# EasyEDA Pro project foc_opam.eprj, board PCB1
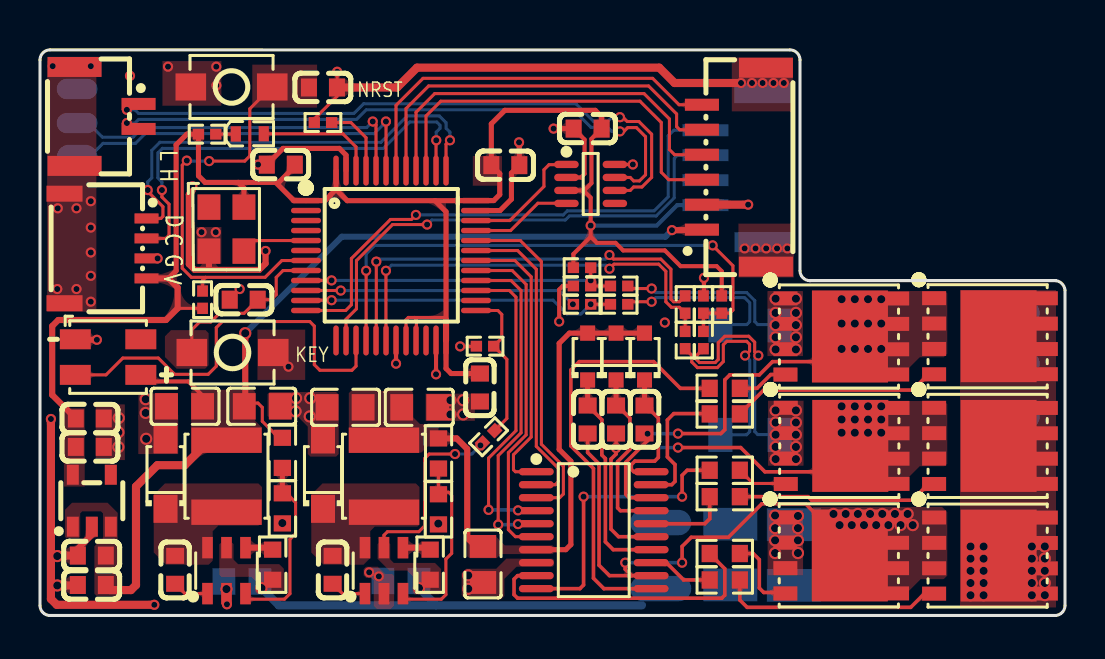
[diagram p1: board, top side]
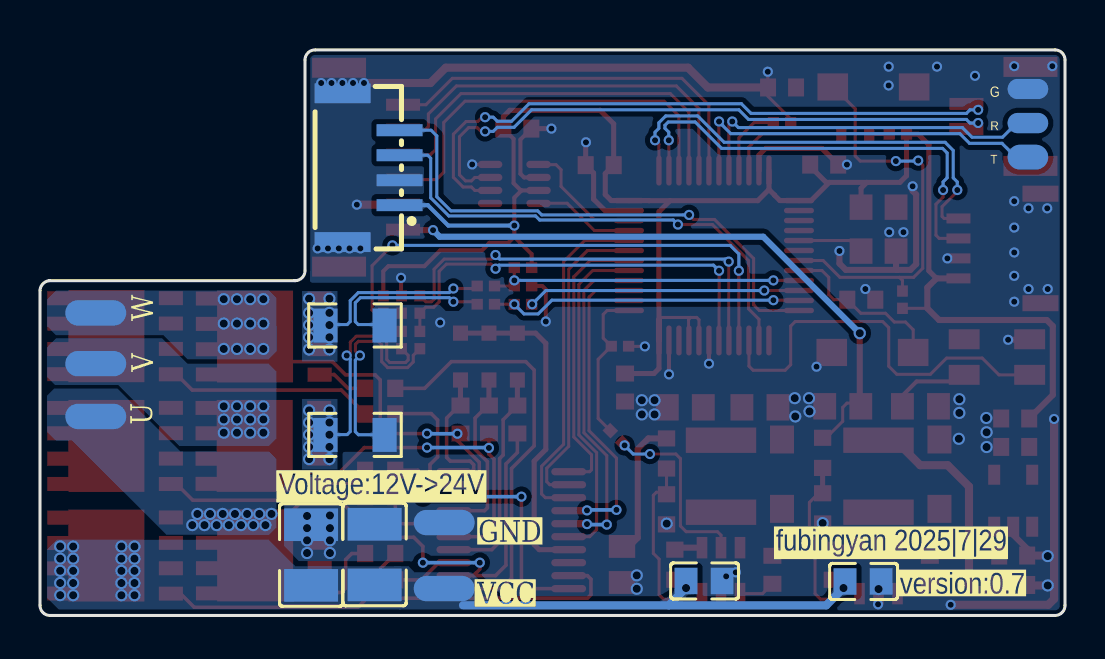
[diagram p2: board, bottom side, seen from below]

Outline 51.25 x 28.3 mm; copper layers: Top Layer, Bottom Layer. Coordinates in mm from the lower left corner of the outline.
Outline path: 0,27.8 arc(0.15,28.15) 0.5,28.3 37.49,28.3 arc(37.85,28.15) 38,27.79 38,17.25 arc(38.15,16.9) 38.5,16.75 50.8,16.75 arc(51.11,16.59) 51.25,16.27 51.25,0.5 arc(51.1,0.15) 50.75,0 0.5,0 arc(0.15,0.15) 0,0.5 0,27.8
Stack: Top Layer 0.035mm / Dielectric1 1.51mm FR4 er 4.5 / Bottom Layer 0.035mm

## Design rules (mm)
net SWD: DP2
net SWC: DP2
net H: DP1
net L: DP1
template: 自定义配置
spacing copperThickness1oz (default): track to track 0.102, other pairs 0.152 to 0.3
spacing copperThickness2oz: track to track 0.203, other pairs 0.152 to 0.3
track width copperThickness1oz (default): min 0.127, default 0.254, max 2.54
track width copperThickness2oz: min 0.203, default 0.254, max 2.54
differential pair differentialPair (default): width min 0.127, default 0.152, max 2.54; gap min 0.152, default 0.152
via viaSize (default): diameter min 0.5, default 0.61, max 10; hole min 0.3, default 0.305, max 6.3
net GND uses copperRegion1

## Placement (name value [footprint] x y rotation side)
C1  100nF  [C0603]  10.19 15.8 180 top
C2  100nF  [C0603]  2.49 8.43 180 top
C3  10uF  [C0603]  2.49 9.86 180 top
C4  10uF  [C0603]  2.59 3 0 top
C5  100nF  [C0603]  2.59 1.52 0 top
C6  100nF  [C0603]  6.76 2.29 90 top
C7  10uF  [C0805]  11.12 10.47 180 top
C8  1uF  [C0805]  7.21 10.47 0 top
C9  100nF  [C0603]  27.38 24.36 0 top
C10  100nF  [C0603_1]  12.04 22.56 0 top
C11  100nF  [C0603_1]  22 11.4 90 top
C12  100nF  [C0603]  14.63 2.29 90 top
C13  100nF  [C0603_1]  23.27 22.53 180 top
C14  10uF  [C0805]  15.24 10.41 0 top
C15  1uF  [C0805]  19 10.41 180 top
C16  10uF  [C0805]  22.15 2.54 90 top
C17  1uF  [C0603]  27.38 9.8 270 top
C18  1uF  [C0603]  28.8 9.8 270 top
C19  1uF  [C0603]  30.23 9.8 270 top
C20  10uF  [C1210]  34.52 3.05 270 bottom
C21  10uF  [C1210]  37.69 3.02 270 bottom
C22  10nF  [C0603]  14.15 26.42 0 top
C23  10uF  [C0805]  18.06 1.73 180 bottom
C24  10uF  [C0805]  10.11 1.7 180 bottom
CN1  HDGC1002WR-S-4P  [CONN-SMD_4P-P1.00_HDGC_HDGC1002WR-S-4P]  3.28 18.36 270 top
CN3  GH1.25-2P卧贴  [CONN-SMD_2P-P1.25_X1251WRS-02HF-LPSW]  3.33 24.97 270 top
D1  DSK210  [SOD-123FL_L2.7-W1.8-LS3.8-RD]  6.28 7.07 90 top
D2  DSK210  [SOD-123FL_L2.7-W1.8-LS3.8-RD]  14.15 7.07 90 top
D3  B5819WS  [SOD-323_L1.8-W1.3-LS2.5-RD]  27.38 12.95 90 top
D4  B5819WS  [SOD-323_L1.8-W1.3-LS2.5-RD]  28.8 12.95 90 top
D5  B5819WS  [SOD-323_L1.8-W1.3-LS2.5-RD]  30.23 12.95 90 top
L1  3.3uH  [IND-SMD_L4.0-W4.0_SMNR4020]  9.32 6.97 270 top
L2  3.3uH  [IND-SMD_L4.0-W4.0_SMNR4020]  17.2 6.97 270 top
LED1  YLED0603R  [LED_0603]  10.49 24.1 0 top
LED2  WS2812B-Mini  [LED-SMD_4P-L3.5-W3.5-TL_WS2812B]  3.4 12.93 180 top
NOREF  -  [Pad_e789]  48.46 9.96 0 top
NOREF#2  -  [Pad_e786]  48.46 15.14 0 top
NOREF#3  -  [Pad_e3962]  1.86 26.34 0 top
NOREF#4  -  [Pad_e2611]  31.04 1.35 180 top
NOREF#5  -  [Pad_e788]  48.46 12.6 0 top
NOREF#6  -  [Pad_e1284]  31.04 4.65 180 top
R  -  [Test-Point-0.5mm]  1.86 24.64 270 bottom
R1  10kΩ  [R0402]  14.15 24.66 180 top
R2  2.2Ω  [R0603]  34.24 10.08 0 top
R3  10kΩ  [R0402]  8.36 24.08 180 top
R4  10mΩ  [R1206]  35.5 14.51 0 bottom
R5  10mΩ  [R1206]  35.5 9.03 0 bottom
R6  10kΩ  [R0402]  8.13 15.8 90 top
R8  1kΩ  [R0603]  12.12 5.36 90 top
R9  5.1kΩ  [R0603]  12.12 8.14 270 top
R10  100k  [R0603]  11.63 2.54 90 top
R11  22kΩ  [R0402]  27.1 17.4 180 top
R12  22kΩ  [R0402]  34.09 15.56 90 top
R13  750Ω  [R0603]  19.92 5.31 90 top
R14  10kΩ  [R0603]  19.92 8.1 270 top
R15  100k  [R0603]  19.51 2.54 90 top
R16  1.5kΩ  [R0402]  28.96 16.48 0 top
R17  1.5kΩ  [R0402]  33.17 13.78 270 top
R18  22kΩ  [R0402]  27.1 16.48 0 top
R19  22kΩ  [R0402]  33.17 15.56 270 top
R20  1.5kΩ  [R0402]  28.96 15.57 0 top
R21  11kΩ  [R0402]  27.1 15.57 0 top
R22  1.5kΩ  [R0402]  32.26 13.78 270 top
R23  11kΩ  [R0402]  32.26 15.56 270 top
R24  22kΩ  [R0402]  22.43 8.94 45 top
R25  1kΩ  [R0402]  22.25 13.47 0 top
SW1  轻触按键3*4*H  [SW-SMD_L4.0-W2.9-LS5.0]  9.63 13.16 0 top
SW2  轻触按键3*4*H  [SW-SMD_L4.0-W2.9-LS5.0]  9.58 26.44 180 top
T  -  [Test-Point-0.5mm#2]  1.86 22.93 180 bottom
U1  -  [SOT-23-5_L3.0-W1.7-P0.95-LS2.8-BR]  2.59 5.74 270 top
U2  CJAC130SN04  [PDFN-8_L5.8-W4.9-P1.27-LS6.1-BL]  47.5 13.97 270 top
U3  CJAC130SN04  [PDFN-8_L5.8-W4.9-P1.27-LS6.1-BL]  47.5 8.48 270 top
U4  CJAC130SN04  [PDFN-8_L5.8-W4.9-P1.27-LS6.1-BL]  47.5 3 270 top
U5  STM32G431CBT6  [LQFP-48_L7.0-W7.0-P0.50-LS9.0-BL]  17.55 18.01 270 top
U6  2.2R  [R0603]  34.24 5.94 0 top
U7  2.2R  [R0603]  34.24 1.78 0 top
U8  CJAC130SN04  [PDFN-8_L5.8-W4.9-P1.27-LS6.1-BL]  40.06 13.96 270 top
U9  CJAC130SN04  [PDFN-8_L5.8-W4.9-P1.27-LS6.1-BL]  40.08 8.48 270 top
U10  CJAC130SN04  [PDFN-8_L5.8-W4.9-P1.27-LS6.1-BL]  40.06 3 270 top
U11  2.2R  [R0603]  34.24 3.1 0 top
U12  2.2R  [R0603]  34.24 11.36 0 top
U13  2.2R  [R0603]  34.24 7.26 0 top
U15  TD1466TR  [SOT-23-6_L2.9-W1.6-P0.95-LS2.8-BL]  9.32 2.24 0 top
U16  MAX3051EKA+T  [SOT-23-8_L3.0-W1.7-P0.65-LS2.8-TL]  27.53 21.59 0 top
U18  TD1466TR  [SOT-23-6_L2.9-W1.6-P0.95-LS2.8-BL]  17.2 2.24 0 top
U19  FD6288T  [TSSOP-20_L6.5-W4.4-P0.65-LS6.4-BL]  27.69 4.27 270 top
U20  XY-GH1.25-6A61  [CONN-SMD_6P-P1.25_XYECONN_XY-GH1.25-6A61]  34.7 22.43 90 top
U21  GH1.25-4P卧贴  [CONN-SMD_4P-P1.25_GH1.25-4P]  34.7 22.4 270 bottom
X1  8MHz  [OSC-SMD_4P-L3.2-W2.5-BL]  9.32 19.33 270 top

## Footprints (pads in the part's own frame, mm; a bottom-side part is the same pattern mirrored in y, then rotated)
C0603
  rect 0.8x0.9 smd: 1(-0.7,0) 2(0.7,0)
C0603_1
  rect 0.8x0.9 smd: 1(-0.7,0) 2(0.7,0)
C0805
  rect 1.143x1.321 smd: 1(-0.889,0) 2(0.914,0)
C1210
  rect 1.635x2.7 smd: 1(-1.518,0) 2(1.518,0)
CONN-SMD_2P-P1.25_X1251WRS-02HF-LPSW
  rect 0.6x1.7 smd: 1(-0.625,1.6) 2(0.625,1.6)
  rect 1x2.7 smd: 3(2.475,-1.6) 4(-2.475,-1.6)
CONN-SMD_4P-P1.00_HDGC_HDGC1002WR-S-4P
  rect 0.5x1.2 smd: 1(-1.5,2.05) 2(-0.5,2.05) 3(0.5,2.05) 4(1.5,2.05)
  rect 0.8x1.8 smd: 5(2.741,-2.05) 6(-2.739,-2.05)
CONN-SMD_4P-P1.25_GH1.25-4P
  rect 0.6x2.3 smd: 1(1.875,1.425) 2(0.625,1.425) 3(-0.625,1.425) 4(-1.875,1.425)
  rect 1x2.8 smd: 5(-3.725,-1.425) 6(3.725,-1.425)
CONN-SMD_6P-P1.25_XYECONN_XY-GH1.25-6A61
  rect 0.6x1.7 smd: 1(-3.125,1.6) 2(-1.875,1.6) 3(-0.625,1.6) 4(0.625,1.6) 5(1.875,1.6) 6(3.125,1.6)
  rect 1x2.7 smd: 7(4.975,-1.6) 8(-4.975,-1.6)
IND-SMD_L4.0-W4.0_SMNR4020
  rect 1.27x3.521 smd: 1(1.801,0) 2(-1.801,0)
LED-SMD_4P-L3.5-W3.5-TL_WS2812B
  rect 1.545x0.997 smd: 1(-1.637,0.89) 2(-1.637,-0.89) 3(1.637,-0.89) 4(1.637,0.89)
LED_0603
  rect 0.508x0.762 smd: 1(-0.699,-0.01) 2(0.699,-0.005)
LQFP-48_L7.0-W7.0-P0.50-LS9.0-BL
  oval 0.27x1.5 smd: 1(-2.75,-4.25) 2(-2.25,-4.25) 3(-1.75,-4.25) 4(-1.25,-4.25) 5(-0.75,-4.25) 6(-0.25,-4.25) 7(0.25,-4.25) 8(0.75,-4.25) 9(1.25,-4.25) 10(1.75,-4.25) 11(2.25,-4.25) 12(2.75,-4.25) 25(2.75,4.25) 26(2.25,4.25) 27(1.75,4.25) 28(1.25,4.25) 29(0.75,4.25) 30(0.25,4.25) 31(-0.25,4.25) 32(-0.75,4.25) 33(-1.25,4.25) 34(-1.75,4.25) 35(-2.25,4.25) 36(-2.75,4.25)
  oval 1.5x0.27 smd: 13(4.25,-2.75) 14(4.25,-2.25) 15(4.25,-1.75) 16(4.25,-1.25) 17(4.25,-0.75) 18(4.25,-0.25) 19(4.25,0.25) 20(4.25,0.75) 21(4.25,1.25) 22(4.25,1.75) 23(4.25,2.25) 24(4.25,2.75) 37(-4.25,2.75) 38(-4.25,2.25) 39(-4.25,1.75) 40(-4.25,1.25) 41(-4.25,0.75) 42(-4.25,0.25) 43(-4.25,-0.25) 44(-4.25,-0.75) 45(-4.25,-1.25) 46(-4.25,-1.75) 47(-4.25,-2.25) 48(-4.25,-2.75)
OSC-SMD_4P-L3.2-W2.5-BL
  rect 1.27x1.143 smd: 1(-1.1,-0.875) 2(1.1,-0.875) 3(1.1,0.875) 4(-1.1,0.875)
Pad_e786
  oval 3.048x1.27 smd far side: 1(0,0)
Pad_e788
  oval 3.048x1.27 smd far side: 1(0,0)
Pad_e789
  oval 3.048x1.27 smd far side: 1(0,0)
Pad_e1284
  oval 3.048x1.27 smd far side: 1(0,0)
Pad_e2611
  oval 3.048x1.27 smd far side: 1(0,0)
Pad_e3962
  oval 2.032x1.016 smd far side: 2(0,0)
PDFN-8_L5.8-W4.9-P1.27-LS6.1-BL
  rect 0.7x1.2 smd: 1(-1.905,-2.792) 2(-0.635,-2.792) 3(0.635,-2.792) 4(1.905,-2.792) 5(1.9,2.792) 6(0.64,2.792) 7(-0.63,2.792) 8(-1.9,2.792)
  rect 4.6x3.8 smd: 9(0,0.432)
R0402
  rect 0.566x0.54 smd: 1(-0.433,0) 2(0.433,0)
R0603
  rect 0.806x0.864 smd: 1(-0.753,0) 2(0.753,0)
R1206
  rect 1.208x1.701 smd: 1(-1.479,0) 2(1.479,0)
SOD-123FL_L2.7-W1.8-LS3.8-RD
  rect 1.399x1.199 smd: 1(-1.735,0) 2(1.735,0)
SOD-323_L1.8-W1.3-LS2.5-RD
  rect 0.762x0.75 smd: 1(-1.173,0) 2(1.173,0)
SOT-23-5_L3.0-W1.7-P0.95-LS2.8-BR
  rect 1x0.6 smd: 1(1.3,-0.95) 2(1.3,0) 3(1.3,0.95) 4(-1.3,0.95) 5(-1.3,-0.95)
SOT-23-6_L2.9-W1.6-P0.95-LS2.8-BL
  rect 0.532x1.072 smd: 1(-0.95,-1.149) 2(0,-1.149) 3(0.95,-1.149) 4(0.95,1.149) 5(0,1.149) 6(-0.95,1.149)
SOT-23-8_L3.0-W1.7-P0.65-LS2.8-TL
  oval 1.222x0.364 smd: 1(-1.211,0.975) 2(-1.211,0.325) 3(-1.211,-0.325) 4(-1.211,-0.975) 5(1.211,-0.975) 6(1.211,-0.325) 7(1.211,0.325) 8(1.211,0.975)
SW-SMD_L4.0-W2.9-LS5.0
  rect 1.53x1.36 smd: 1(-2.035,0) 2(2.035,0)
Test-Point-0.5mm
  oval 1.016x2.032 smd: 1(0,0)
Test-Point-0.5mm#2
  oval 2.032x1.244 smd: 1(0,0)
TSSOP-20_L6.5-W4.4-P0.65-LS6.4-BL
  oval 0.364x1.742 smd: 1(-2.925,-2.871) 2(-2.275,-2.871) 3(-1.625,-2.871) 4(-0.975,-2.871) 5(-0.325,-2.871) 6(0.325,-2.871) 7(0.975,-2.871) 8(1.625,-2.871) 9(2.275,-2.871) 10(2.925,-2.871) 11(2.925,2.871) 12(2.275,2.871) 13(1.625,2.871) 14(0.975,2.871) 15(0.325,2.871) 16(-0.325,2.871) 17(-0.975,2.871) 18(-1.625,2.871) 19(-2.275,2.871) 20(-2.925,2.871)

## Nets
As in the schematic, except:
GND: C1.2 C2.1 C3.1 C4.1 C5.1 C7.1 C8.1 C9.1 C10.1 C11.1 C13.1 C14.1 C15.1 C16.1 C20.1 C21.1 C22.2 C23.2 C24.2 CN1.3 CN1.5 CN1.6 CN3.3 CN3.4 D1.2 D2.2 LED2.3 NOREF#3.2 NOREF#6.1 R1.2 R4.1 R5.1 R8.1 R13.1 R18.1 R19.1 R20.2 R22.2 R25.1 SW1.2 SW2.2 U1.2 U5.19 U5.23 U5.35 U5.47 U10.1 U10.2 U10.3 U15.2 U16.2 U16.8 U18.2 U19.8 U20.2 U20.7 U20.8 U21.2 U21.5 U21.6 X1.2
VCC: C20.2 C21.2 C23.1 C24.1 NOREF#4.1 R10.1 R15.1 R24.1 U2.5 U2.6 U2.7 U2.8 U2.9 U3.5 U3.6 U3.7 U3.8 U3.9 U4.5 U4.6 U4.7 U4.8 U4.9 U15.5 U18.5
SHA: C19.2 NOREF#2.1 U2.1 U2.2 U2.3 U8.5 U8.6 U8.7 U8.8 U8.9 U19.18
SHB: C18.2 NOREF#5.1 U3.1 U3.2 U3.3 U9.5 U9.6 U9.7 U9.8 U9.9 U19.15
SHC: C17.2 NOREF.1 U4.1 U4.2 U4.3 U10.5 U10.6 U10.7 U10.8 U10.9 U19.12
U1R: R.1 U5.44
U1T: T.1 U5.43

Pads without a net: LED2 2; U1 4; U5 2 3 4 6 13 22 26; U16 5; X1 1

## Via types
v1: diameter 0.508, hole 0.305, Top Layer to Bottom Layer, 96 vias
v2: diameter 0.61, hole 0.406, Top Layer to Bottom Layer, 110 vias

## Routing (per net, layer and track width the routed paths; a pad name or vN(x,y) marks a point on that pad's centre or on a via; arc(x,y) is an arc through that point)
3.3V: length 94.2
  Top Layer w0.152: 18.72,14.91 18.82,14.81 18.82,13.78 U5.21 ; 18.72,14.91 20.19,14.91 20.3,14.8 ; 18.72,14.91 18.41,14.91 18.3,14.8 U5.20 ; R6.1 6.93,15.37
  Top Layer w0.203: 27.17,21.27 27.21,21.27 27.57,21.63 27.57,23.85 C9.2 ; 27.17,21.27 U16.3 ; 27.17,21.27 27.53,20.9 v1(27.53,19.51) 27.53,18.95 ; 27.53,18.95 27.84,18.64 28.78,18.64 29.16,18.26 31.24,18.26 32.03,17.47 33.83,17.47 34.09,17.22 R12.2 ; 27.53,18.95 26.67,18.08 R11.2
  Top Layer w0.254: 14.8,21.31 U5.48 ; 14.8,21.31 15.36,20.75 19.75,20.75 ; 14.8,21.31 14.52,21.04 14.52,21.03 14.26,20.76 U5.1 12.69,20.76 11.79,21.67 ; 9.91,21.67 11.79,21.67 ; 9.91,21.67 8.25,21.67 7.92,22 R3.2 7.34,24.08 6.81,23.55 6.81,17.25 6.42,16.86 ; 9.91,21.67 10.2,21.38 X1.4 ; 11.79,21.67 11.94,21.67 12.74,22.47 C10.2 ; 20.3,14.8 20.3,20.2 19.75,20.75 ; C9.2 28.08,24.95 27.76,25.27 23.24,25.27 22.57,24.6 C13.2 22.99,22.11 22.99,21.06 22.69,20.76 U5.36 20.8,20.76 20.79,20.75 19.75,20.75 ; U5.24 20.3,12.36 20.56,12.1 C11.2
  Top Layer w0.305: CN1.4 6.42,16.86 6.88,16.41 6.88,15.37 6.3,14.78 0.91,14.78 0.61,14.48 0.61,11.03 C3.2 ; 20.3,14.8 U5.24
  Bottom Layer w0.203: v1(27.53,19.51) 30.84,19.51 31.86,20.53 U21.1
+5V: length 48.1
  Top Layer w0.152: 10.16,10.62 10.9,10.62 11.12,10.41 11.12,9.71 11.74,9.09 12.12,9.09
  Top Layer w0.203: LED2.1 5.37,11.71 7.42,11.71 8.4,10.73 C8.2
  Top Layer w0.305: U20.1 33.07,19.28 v1(31.6,19.28) ; 10.21,10.47 10.26,10.52 v2(10.26,14.12)
  Top Layer w0.406: C5.2 3.29,1.48 3.5,1.27 4.55,1.27 4.8,1.52 4.8,6.45 5.87,7.52 7.24,7.52 8.49,8.77 L1.2
  Bottom Layer w0.305: v1(31.6,19.28) 31.27,18.95 15.09,18.95 v2(10.26,14.12)
+12V: length 23.9
  Top Layer w0.152: 18.09,10.88 18.06,10.88
  Top Layer w0.254: U19.7 26.29,3.29 26.54,3.55 26.54,7.72 25.96,8.31 25.96,13.61 26.47,14.13 D3.2 D4.2 D5.2
  Top Layer w0.305: 21.9,3.35 21.36,3.89 21.36,8.33 20.83,8.86 R14.1 ; 18.09,10.88 18.09,10.52
GND: length 99.4
  Top Layer w0.152: U16.8 v1(29.64,22.56) ; R1.2 13.72,24.84 14.85,25.97 C22.2 14.86,26.43 v1(14.86,27.2) ; R22.2 32.59,13.02 32.59,12.68 32.87,12.4 33.87,12.4 34.17,12.7 34.17,13.54 34.34,13.72 35.33,13.72 35.48,13.57 35.48,13.23 v1(35.25,13) ; v1(21.01,13.46) 21.81,13.46 R25.1 ; R20.2 29.52,15.7 v1(30.58,15.7)
  Top Layer w0.203: R19.1 33.2,16.01 33.2,16.89 ; U5.23 v1(19.8,12.06) ; U5.19 v1(17.8,12.6) ; R18.1 26.14,16.48 25.96,16.31 v1(25.96,14.71) ; U16.2 27.05,21.92 27.23,22.1 27.23,23.81 C9.1
  Top Layer w0.254: v1(12.42,12.45) 12.37,12.45 SW1.2 ; U5.47 15.3,23.03 14.97,23.37 12.15,23.37 C10.1 ; U5.35 23,20.26 23.57,20.83 23.57,22.13 C13.1 23.97,23.66 v1(23.95,23.67) ; v1(25.68,24.36) C9.1
  Top Layer w0.305: 1.89,3 1.89,3.34 2.59,4.04 U1.2 ; LED2.3 1.79,13.79 v1(2.84,13.79) ; X1.2 8.45,17.34 8.4,17.29 ; 8.4,17.29 7.73,17.29 7.44,17.58 7.44,21.06 7.62,21.24 v1(7.62,21.47) ; 8.4,17.29 10.96,17.29 11.28,17.61 v1(11.28,18.24)
  Top Layer w0.406: v1(5.72,0.53) 0.84,0.53 0.55,0.83 v1(0.55,9.83) ; v2(0.86,2.97) 0.89,3 1.89,3 ; U20.2 v1(35.41,20.55) ; C22.2 17.86,26.42 18.85,27.41 30.96,27.41 31.73,26.64 v1(35.05,26.64) ; v2(0.86,1.5) 1.87,1.5 1.89,1.52
  Bottom Layer w0.152: v1(30.58,15.7) 30.78,15.9 35.23,15.9 35.48,15.65 35.48,14.7 35.34,14.55 34.58,14.55 34.02,14 ; 33.64,8.5 34.18,9.04 35.33,9.04 35.48,9.19 35.48,12.78 v1(35.25,13)
  vias: v1(0.64,27.48) v1(0.89,20.37) v1(0.86,16.33) v1(1.82,20.37) v1(1.82,16.33) v1(2.54,27.48) v1(2.54,20.73) v1(2.54,19.41) v1(2.54,18.16) v1(2.54,16.99) v1(2.54,15.7) v1(4.5,27) v1(5.88,17.86) v1(6.4,27.46) v1(8.08,19.18) v1(8.81,27.46) v1(8.82,26.52) v1(8.79,19.18) v1(9.35,0.56) v1(9.98,16.33) v1(10.9,22.56) v1(16.46,2.16) v1(16.94,1.96) v1(31.24,14.66) v1(33.2,16.89) v1(35.23,18.36) v1(35.6,26.64) v1(35.78,18.36) v1(36.13,26.64) v1(36.31,18.36) v1(36.67,26.64) v1(36.85,18.36) v1(37.19,26.64) v1(37.37,18.36) v2(3.94,9.88) v2(3.92,9.17) v2(3.92,8.43) v2(5.28,10.82) v2(5.28,10.13) v2(5.31,8.84) v2(9.32,1.32) v2(12.12,4.62) v2(12.8,10.87) v2(12.78,10.21) v2(13.51,10.87) v2(13.49,9.96) v2(19.91,4.6) v2(20.52,10.77) v2(20.52,10.06) v2(21.16,10.77) v2(21.16,10.06) v2(21.41,2.01) v2(21.41,1.34) v2(36.75,5) v2(36.75,4.37) v2(36.75,3.76) v2(36.75,3.12) v2(37.9,4.98) v2(37.9,4.37) v2(37.9,3.76) v2(37.9,3.12)
VCC: length 29.9
  Top Layer w0.152: U18.5 17.2,4.02 17.37,4.19 18.94,4.19 19.23,4.48 19.23,7.85 19.46,8.08 v1(20.75,8.08)
  Bottom Layer w0.152: v1(20.75,8.08) 21.59,8.08 v1(22.02,8.51)
  Bottom Layer w0.406: v2(11.07,1.37) 11.94,0.51 19.81,0.51 ; 19.81,0.51 30.1,0.51 ; 19.81,0.51 v2(18.95,1.37)
  vias: v2(46.53,3.45) v2(46.53,2.84) v2(46.53,2.23) v2(46.53,1.62) v2(46.53,1.01) v2(47.18,3.45) v2(47.18,2.84) v2(47.18,2.23) v2(47.18,1.62) v2(47.18,1.01) v2(49.59,3.45) v2(49.59,2.84) v2(49.59,2.23) v2(49.59,1.62) v2(49.59,1.01) v2(50.24,3.45) v2(50.24,2.84) v2(50.24,2.23) v2(50.24,1.63) v2(50.24,1.02)
CAN_RX: length 5.3
  Top Layer w0.152: 26.54,20.62 24.9,20.62 23.53,19.26 U5.33
CAN_TX: length 6.4
  Top Layer w0.152: 26.52,22.56 25.45,22.56 25.2,22.3 25.2,21.46 23.49,19.76 U5.34
CLK: length 19.8
  Top Layer w0.152: 33.1,23.05 31.73,23.05 31.47,23.31 31.47,24.84 30.2,26.11 19.74,26.11 18.8,25.18 U5.40
CSN: length 19.9
  Top Layer w0.152: U5.39 19.3,24.99 20.04,25.73 30,25.73 31.06,24.66 31.06,22.17 31.44,21.8 U20.3
GHA: length 6.6
  Top Layer w0.178: 33.37,10.1 31.69,10.1 31.37,9.78 31.37,7.93 31.75,7.55 31.75,6.71 31.59,6.54 30.56,6.54
GHB: length 4.1
  Top Layer w0.178: 30.56,4.59 33.24,4.59 33.49,4.83 U6.1
GHC: length 3.3
  Top Layer w0.178: U7.1 32.18,1.78 31.34,2.62 30.58,2.62 30.56,2.64
GLA: length 21.7
  Top Layer w0.178: U12.1 32.02,11.36 30.68,12.7 26.96,12.7 26.54,12.28 26.54,8.48 27.67,7.35 27.67,1.86 28.19,1.34 30.56,1.34
GLB: length 14.3
  Top Layer w0.178: U19.10 27,1.34 27.18,1.52 v1(27.18,5.94) ; U13.1 32.36,7.26 32.11,7.01 v1(32.11,5.94)
  Bottom Layer w0.178: v1(27.18,5.94) v1(32.11,5.94)
GLC: length 15.7
  Top Layer w0.178: 25.45,1.99 U19.9 23.88,1.99 23.7,1.81 23.7,1.04 23.88,0.86 34.09,0.86 34.24,1.02 34.24,2.34 33.49,3.09
H: length 30.6
  Top Layer w0.152: U16.7 29.51,21.92 29.68,21.74 29.97,21.74 30.28,22.05 30.28,23.95 29.82,24.41 29.39,24.41 29.2,24.22 v1(29,24.22)
  Bottom Layer w0.152: v1(4.34,24.64) 4.75,24.64 4.93,24.82 15.82,24.82 16.31,25.3 26.67,25.3 27.55,24.42 28.38,24.42 28.59,24.22 v1(29,24.22)
HALL0: length 26.8
  Top Layer w0.152: U5.12 15.28,15.26 15.57,15.55 15.57,17.86 17.52,19.81 18.57,19.81 v1(18.8,20.04)
  Bottom Layer w0.152: U21.4 31.69,24.28 31.41,23.99 31.41,20.95 30.7,20.24 26.36,20.24 26.16,20.04 v1(18.8,20.04)
HALL1: length 25
  Top Layer w0.152: v1(19.35,19.56) 17.63,19.56 15.82,17.75 15.82,15.34 15.3,14.82 U5.14
  Bottom Layer w0.152: U21.3 31.87,23.03 31.71,22.88 31.71,20.89 30.81,19.99 26.47,19.99 26.27,19.79 19.58,19.79 v1(19.35,19.56)
HIN1: length 14.3
  Top Layer w0.152: U5.30 23.75,17.76 24.56,16.94 24.56,8.93 23.67,8.04 23.67,7.29 23.77,7.19 U19.1
HIN2: length 15.6
  Top Layer w0.152: U5.31 23.88,18.26 24.81,17.32 24.81,8.46 25.91,7.36 25.91,6.69 25.76,6.54 U19.2
HIN3: length 17.2
  Top Layer w0.152: U5.32 24.01,18.76 25.07,17.7 25.07,8.57 26.17,7.47 26.17,6.08 25.98,5.89 U19.3
KEY0: length 8.6
  Top Layer w0.152: SW1.1 7.59,14.3 7.98,14.68 8.53,14.68 8.97,15.12 10.21,15.12 C1.1 11.56,15.8 11.81,16.05 11.81,16.92 12.15,17.26 U5.8
L: length 31.6
  Top Layer w0.152: v1(29,24.93) 29.15,24.93 29.36,24.71 29.95,24.71 30.58,24.08 30.58,21.92 30.1,21.44 29.68,21.44 29.51,21.27 U16.6
  Bottom Layer w0.152: v1(4.34,25.3) 4.75,25.3 4.93,25.12 15.7,25.12 16.18,25.6 26.8,25.6 27.67,24.73 28.38,24.73 28.59,24.93 v1(29,24.93)
LED: length 6.1
  Top Layer w0.152: LED1.2 15.14,24.1 15.8,23.44 U5.46
LIN1: length 15.8
  Top Layer w0.152: U5.27 23.47,16.26 23.8,15.93 23.8,9.25 22.43,7.87 v1(22.43,5.28)
  Top Layer w0.203: U19.4 24.8,5.26 v1(23.9,5.26)
  Bottom Layer w0.178: v1(22.43,5.28) 23.88,5.28 v1(23.9,5.26)
LIN2: length 16.6
  Top Layer w0.152: U5.28 23.55,16.76 24.05,16.26 24.05,9.14 22.91,8 v1(22.91,4.55)
  Top Layer w0.203: U19.5 24.79,4.57 v1(23.9,4.57)
  Bottom Layer w0.178: v1(23.9,4.57) 23.88,4.55 v1(22.91,4.55)
LIN3: length 17
  Top Layer w0.152: U19.6 23.77,3.94 23.42,4.29 23.42,8.15 24.31,9.03 24.31,16.56 23.61,17.26 U5.29
MISO: length 19.6
  Top Layer w0.152: U5.41 18.3,25.36 19.43,26.49 30.43,26.49 31.83,25.09 31.83,24.46 31.98,24.3 U20.5
MOSI: length 19.7
  Top Layer w0.152: U20.6 31.95,25.55 30.63,26.87 19.15,26.87 17.8,25.52 U5.42
NRST: length 20.2
  Top Layer w0.152: R6.2 8.13,16.76 8.28,16.92 ; 8.28,16.92 7.57,16.92 7.11,17.37 7.11,22.53 v1(7.34,22.76) ; 8.28,16.92 11.25,16.92 12.09,17.76 U5.7 ; SW2.1 11.58,26.44 10.49,25.35 10.49,22.99 10.24,22.73 v1(8.46,22.73)
  Bottom Layer w0.152: v1(7.34,22.76) 7.37,22.73 v1(8.46,22.73)
OP1_VINM: length 15.7
  Top Layer w0.152: v1(14.58,15.77) 13.32,15.77 U5.11 ; v1(27.53,15.57) R20.1
  Bottom Layer w0.152: v1(27.53,15.57) 27.05,15.09 26.34,15.09 25.65,15.77 v1(14.58,15.77)
OP1_VINP: length 16.1
  Top Layer w0.152: U5.9 13.31,16.76 v1(14.58,16.76) ; 27.53,17.4 v1(27.53,16.76) 27.53,16.48 R16.1
  Bottom Layer w0.152: v1(27.53,16.76) v1(14.58,16.76)
OP1_VOUT: length 13.7
  Top Layer w0.152: v1(15.04,16.26) 15.03,16.26 U5.10 ; v1(26.64,15.57) R21.1
  Bottom Layer w0.152: v1(26.64,15.57) 25.96,16.26 v1(15.04,16.26)
OP3_VINM: length 21.6
  Top Layer w0.152: v1(17.3,17.25) 17.3,13.76 U5.18 ; v1(28.47,17.35) 28.7,17.58 30.93,17.58 31.29,17.22 31.29,15.69 31.57,15.42 31.96,15.42 R23.2 R22.1
  Bottom Layer w0.152: v1(28.47,17.35) 28.3,17.53 17.58,17.53 v1(17.3,17.25)
OP3_VINP: length 27.9
  Top Layer w0.152: U5.16 16.31,13.76 v1(16.31,17.25) ; v1(33.63,18.52) 34.65,17.5 34.65,15.28 34.49,15.12 R12.1 R19.2 R17.1
  Bottom Layer w0.152: v1(33.63,18.52) 16.74,18.52 16.31,18.08 v1(16.31,17.25)
OP3_VOUT: length 21.5
  Top Layer w0.152: v1(28.47,18.03) 28.68,17.83 31.04,17.83 31.55,17.32 31.55,15.82 31.67,15.7 31.97,15.7 R23.1 ; v1(16.81,17.7) 16.81,13.77 U5.17
  Bottom Layer w0.152: v1(28.47,18.03) 28.27,17.83 16.94,17.83 v1(16.81,17.7)
RCC: length 3.3
  Top Layer w0.152: 10.2,18.2 10.75,18.76 U5.5
SESU_P: length 9.4
  Top Layer w0.152: v1(30.58,16.36) 29.52,16.36 R16.2
  Bottom Layer w0.152: v1(30.58,16.36) 30.78,16.15 35.34,16.15 35.74,15.75 35.74,14.71 35.89,14.55 36.78,14.55 v2(36.78,13.92)
  vias: v2(36.78,15.85) v2(36.78,15.14) v2(36.78,14.53) v2(36.78,13.31) v2(37.79,15.85) v2(37.79,15.14) v2(37.79,14.53) v2(37.79,13.92) v2(37.79,13.31)
SESV_P: length 11.1
  Top Layer w0.152: v1(35.92,13) 35.73,13.19 35.73,13.67 35.44,13.97 34.24,13.97 33.91,13.65 33.91,12.81 33.76,12.65 32.97,12.65 32.84,12.79 32.84,13.02 R17.2
  Bottom Layer w0.152: 36.98,8.5 36.98,8.69 36.62,9.05 35.89,9.05 35.74,9.2 35.74,12.83 v1(35.92,13)
  vias: v2(36.78,10.26) v2(36.78,9.65) v2(36.78,9.04) v2(36.78,8.43) v2(36.78,7.82) v2(37.79,10.26) v2(37.79,9.65) v2(37.79,9.04) v2(37.79,8.43) v2(37.79,7.82)
SHA: length 20.1
  Top Layer w0.178: 30.56,5.89 29.46,5.89 29.29,6.07 29.29,7.66 30.38,8.75 v1(30.38,9.09) 29.92,9.09 ; v1(31.9,9.1) 34.04,9.1 34.24,9.3 34.24,11.79 34.49,12.04 35.97,12.04 36.63,12.7 39.62,12.7 40.52,13.6 40.52,14.95
  Bottom Layer w0.178: v1(31.9,9.1) 31.89,9.09 v1(30.38,9.09)
  vias: v2(40.08,15.82) v2(40.08,14.61) v2(40.08,13.33) v2(40.74,15.82) v2(40.74,14.61) v2(40.74,13.33) v2(41.4,15.82) v2(41.4,14.61) v2(41.4,13.33) v2(42.06,15.82) v2(42.06,14.61) v2(42.06,13.33)
SHB: length 20
  Top Layer w0.178: 30.56,3.94 28.93,3.94 28.55,4.32 28.55,7.82 28.8,8.08 v1(28.8,8.38) C18.2 ; 40.48,8.98 38.69,7.19 36.25,7.19 35.03,8.4 v1(31.9,8.4)
  Bottom Layer w0.178: v1(31.9,8.4) 28.82,8.4 v1(28.8,8.38)
  vias: v2(40.08,10.47) v2(40.08,9.8) v2(40.08,9.14) v2(40.74,10.47) v2(40.74,9.8) v2(40.74,9.14) v2(41.4,10.47) v2(41.4,9.8) v2(41.4,9.14) v2(42.06,10.47) v2(42.06,9.8) v2(42.06,9.14)
SHC: length 24.3
  Top Layer w0.178: 27.38,8.8 27.38,8.15 27.95,7.58 27.95,2.51 28.47,1.99 29.58,1.99 ; 29.58,1.99 30.56,1.99 ; 29.58,1.99 29.26,2.31 v1(29.26,2.64) ; v1(32.11,2.64) 32.11,3.45 32.56,3.91 34.42,3.91 36.09,5.59 38.28,5.59 40.49,3.37 40.49,3.06
  Bottom Layer w0.178: v1(32.11,2.64) v1(29.26,2.64)
  vias: v2(39.68,5.08) v2(39.98,4.52) v2(40.28,5.08) v2(40.59,4.52) v2(40.89,5.08) v2(41.2,4.52) v2(41.5,5.08) v2(41.81,4.52) v2(42.11,5.08) v2(42.42,4.52) v2(42.75,5.08) v2(43.03,4.52) v2(43.38,5.08) v2(43.64,4.52)
SWC: length 22.7
  Top Layer w0.152: CN1.2 6.29,18.86 6.45,19.03 6.45,20.58 6.1,20.93 v1(6.1,21.28) ; v1(19.81,23.77) 19.8,23.76 U5.38
  Bottom Layer w0.152: v1(6.1,21.28) 6.1,21.69 5.89,21.89 5.89,23.14 6.12,23.37 17.17,23.37 18.49,24.69 19.84,24.69 20,24.52 20,24.37 19.81,24.18 v1(19.81,23.77)
SWD: length 22.7
  Top Layer w0.152: CN1.1 6.05,19.86 6.15,19.97 6.15,20.45 5.39,21.21 v1(5.39,21.28) ; v1(20.5,23.77) 20.3,23.58 U5.37
  Bottom Layer w0.152: v1(20.5,23.77) 20.5,24.18 20.31,24.37 20.31,24.65 19.96,24.99 18.36,24.99 17.04,23.67 5.99,23.67 5.59,23.27 5.59,21.89 5.39,21.69 v1(5.39,21.28)
U1R: length 17.9
  Top Layer w0.152: U5.44 16.8,24.55 v1(16.64,24.71)
  Bottom Layer w0.152: v1(16.64,24.71) 16.33,24.41 5.13,24.41 4.65,23.93 3.12,23.93 2.52,24.53 1.96,24.53 R.1
U1T: length 18.6
  Top Layer w0.152: U5.43 17.3,24.71 v1(17.3,24.71)
  Bottom Layer w0.152: T.1 2.46,22.93 3.15,23.62 4.77,23.62 5.26,24.1 16.71,24.1 17.12,24.51 17.12,24.54 v1(17.3,24.71)
V_ADC: length 7.9
  Top Layer w0.152: U5.25 22.89,15.26 23.09,15.06 23.09,13.88 22.69,13.47 23.34,12.81 23.34,9.86 R24.2
VB1: length 6.9
  Top Layer w0.178: 30.56,7.19 29.69,7.19 29.57,7.31 29.57,7.54 29.74,7.72 30.73,7.72 30.92,7.91 30.92,9.88 30.33,10.47
  Top Layer w0.254: D5.1 C19.1
VB2: length 8.7
  Top Layer w0.178: 28.8,10.57 29.5,9.88 29.5,8.31 28.88,7.7 28.88,5.38 29.02,5.24 30.56,5.24
  Top Layer w0.254: C18.1 D4.1
VB3: length 10.9
  Top Layer w0.178: 30.56,3.29 28.66,3.29 28.27,3.68 28.27,7.85 28.09,8.03 28.09,9.79 C17.1
  Top Layer w0.254: D3.1 C17.1
WS2812: length 20.5
  Top Layer w0.152: U5.15 15.8,12.47 15.6,12.27 13.99,12.27 13.72,12.55 13.72,14.48 13.49,14.71 9.12,14.71 8.81,14.4 8.81,12.47 8.41,12.06 6.73,12.06 5.92,12.88 4.14,12.88 3.3,12.04 LED2.4
$1N2430: length 1.4
  Top Layer w0.305: 19.51,3.39 19.5,3.39 U18.4
$1N2434: length 1.8
  Top Layer w0.152: C12.1 15.12,1.09 16.25,1.09
$1N2440: length 9.6
  Top Layer w0.152: U18.3 18.15,0.81 20.07,0.81 20.29,1.04 20.29,2.82 20.58,3.11 20.58,6.01 20.43,6.17 19.92,6.17 19.92,7.45
$1N5416: length 2.6
  Top Layer w0.178: U8.4 36.54,12.05 35.85,11.36 U12.2
$1N5594: length 10.5
  Top Layer w0.178: 44.63,12.27 43.64,11.28 36.19,11.28 R2.2
$1N5708: length 2.6
  Top Layer w0.152: 37.26,6.69 37.17,6.6 35.65,6.6 U13.2
$1N5922: length 10.1
  Top Layer w0.178: U3.4 44.42,6.58 43.61,5.77 38.58,5.77 38.41,5.94 U6.2
$1N6055: length 4
  Top Layer w0.178: 34.95,3.1 35.66,3.1 35.97,2.79 35.97,1.37 36.19,1.15 37.27,1.15
$1N6187: length 11.1
  Top Layer w0.178: 44.6,1.19 44.32,1.19 43.54,0.41 35.36,0.41 34.99,0.77 U7.2
$1N8102: length 1.4
  Top Layer w0.305: 11.63,3.39 11.63,3.39 10.28,3.39
$1N8110: length 1.8
  Top Layer w0.152: C6.1 7.25,1.09 U15.1
$1N8122: length 9.5
  Top Layer w0.152: 10.28,1.09 10.28,0.81 12.22,0.81 12.5,1.09 12.5,3.81 12.78,4.09 12.78,5.66 12.12,6.32
  Top Layer w0.254: 12.12,7.59 12.12,6.32
$1N34157: length 3.7
  Top Layer w0.152: U5.45 16.3,23.91 15.54,24.66 R1.1
$1N46388: length 1
  Top Layer w0.152: R3.1 9.78,24.08 LED1.1

## Copper pours and planes (outline as drawn; the poured copper is in the pictures)
3.3V on Top Layer: 21.64,22.99 23.1,22.99 23.1,21.5 21.64,21.5
3.3V on Top Layer: 1.19,10.36 2.24,10.36 2.24,6.45 1.19,6.45
+5V on Top Layer: 7.56,11.29 11.09,11.29 11.09,8.17 7.56,8.17
+5V on Top Layer: 1.24,5.64 3.89,5.64 3.89,0.99 1.24,0.99
+12V on Top Layer: 18.97,9.58 19.92,9.58 19.92,8.46 18.97,8.46
+12V on Top Layer: 21.36,4.01 25.71,4.01 25.71,2.87 21.36,2.87
+12V on Top Layer: 15.44,11.23 19.69,11.23 19.69,8.15 15.44,8.15
GND on Top Layer: 6.12,27.74 9.07,27.74 9.07,25.5 6.12,25.5
GND on Top Layer: 7.82,19.43 9.07,19.43 9.07,17.6 7.82,17.6
GND on Top Layer: 34.59,27.91 37.64,27.91 37.64,25.22 34.59,25.22
GND on Top Layer: 4.92,11.11 6.88,11.11 6.88,9.8 4.92,9.8
GND on Top Layer: 16.18,2.44 17.7,2.44 17.7,0.33 16.18,0.33
GND on Top Layer: 36.38,5.27 38.15,5.27 38.15,2.01 36.38,2.01
GND on Top Layer: 11.38,11.18 14.94,11.18 14.94,7.95 11.38,7.95
GND on Top Layer: 34.92,19.61 37.69,19.61 37.69,16.91 34.92,16.91
GND on Top Layer: 10.87,14.3 13.26,14.3 13.26,11.79 10.87,11.79
GND on Top Layer: 4.91,10.03 6.91,10.03 6.91,8.08 4.91,8.08
GND on Top Layer: 0.36,27.74 2.82,27.74 2.82,15.2 0.36,15.2
GND on Top Layer: 19.28,11.1 21.74,11.1 21.74,9.74 19.28,9.74
GND on Top Layer: 21.08,2.84 25.71,2.84 25.71,0.81 21.08,0.81
GND on Top Layer: 2.78,10.56 4.24,10.56 4.24,7.77 2.78,7.77
GND on Bottom Layer: 36.37,7.04 39.04,7.04 39.04,2.72 36.37,2.72
GND on Bottom Layer: -5.31,33.25 37.74,33.25 37.74,-5.26 -5.31,-5.26
VCC on Top Layer: 16.88,3.62 20.05,3.62 20.05,1.05 16.88,1.05
VCC on Top Layer: 8.97,3.63 12.19,3.63 12.19,1.07 8.97,1.07
VCC on Top Layer: 46,16.28 50.8,16.28 50.8,0.4 46,0.4
VCC on Bottom Layer: 33.02,3.78 50.9,3.78 50.9,0.31 33.02,0.31
VCC on Bottom Layer: 28.12,2.46 33.55,2.46 33.55,0.31 28.12,0.31
KEY0 on Top Layer: 6.25,14.28 8.43,14.28 8.43,12.34 6.25,12.34
NRST on Top Layer: 10.62,27.56 13.85,27.56 13.85,25.41 10.62,25.41
SESU_P on Top Layer: 36.37,16.23 38.15,16.23 38.15,12.98 36.37,12.98
SESU_P on Bottom Layer: 36.37,16.23 38.15,16.23 38.15,12.7 36.37,12.7
SESV_P on Top Layer: 36.4,10.75 38.18,10.75 38.18,7.49 36.4,7.49
SESV_P on Bottom Layer: 36.38,10.83 38.15,10.83 38.15,7.3 36.38,7.3
SHA on Top Layer: 41.1,16.23 45.36,16.23 45.36,12.27 41.1,12.27
SHA on Bottom Layer: 39.41,16.26 50.9,16.26 50.9,12.81 39.41,12.81
SHB on Top Layer: 41.05,10.73 45.36,10.73 45.36,6.92 41.05,6.92
SHB on Bottom Layer: 39.42,13.87 50.9,13.87 50.9,8.48 39.42,8.48
SHC on Top Layer: 38.65,5.43 45.36,5.43 45.36,1.22 38.65,1.22
SHC on Bottom Layer: 39.42,11.35 50.9,11.35 50.9,4.03 39.42,4.03
$1N2435 on Top Layer: 13.56,6.6 18.97,6.6 18.97,2.54 13.56,2.54
$1N8111 on Top Layer: 5.69,6.6 11.1,6.6 11.1,2.54 5.69,2.54

Small or netless copper shapes (teardrops, artwork), in the pictures only: 275 on Top Layer, 57 on Bottom Layer

## Text on the board
Bottom Silkscreen Layer: G | version:0.7 | fubingyan 2025|7|29 | Voltage:12V->24V | W | V | U | GND | VCC
Top Silkscreen Layer: KEY | NRST | L | H | V | C | G | D
